# EasyEDA Pro project hardware.eprj, board PCB27
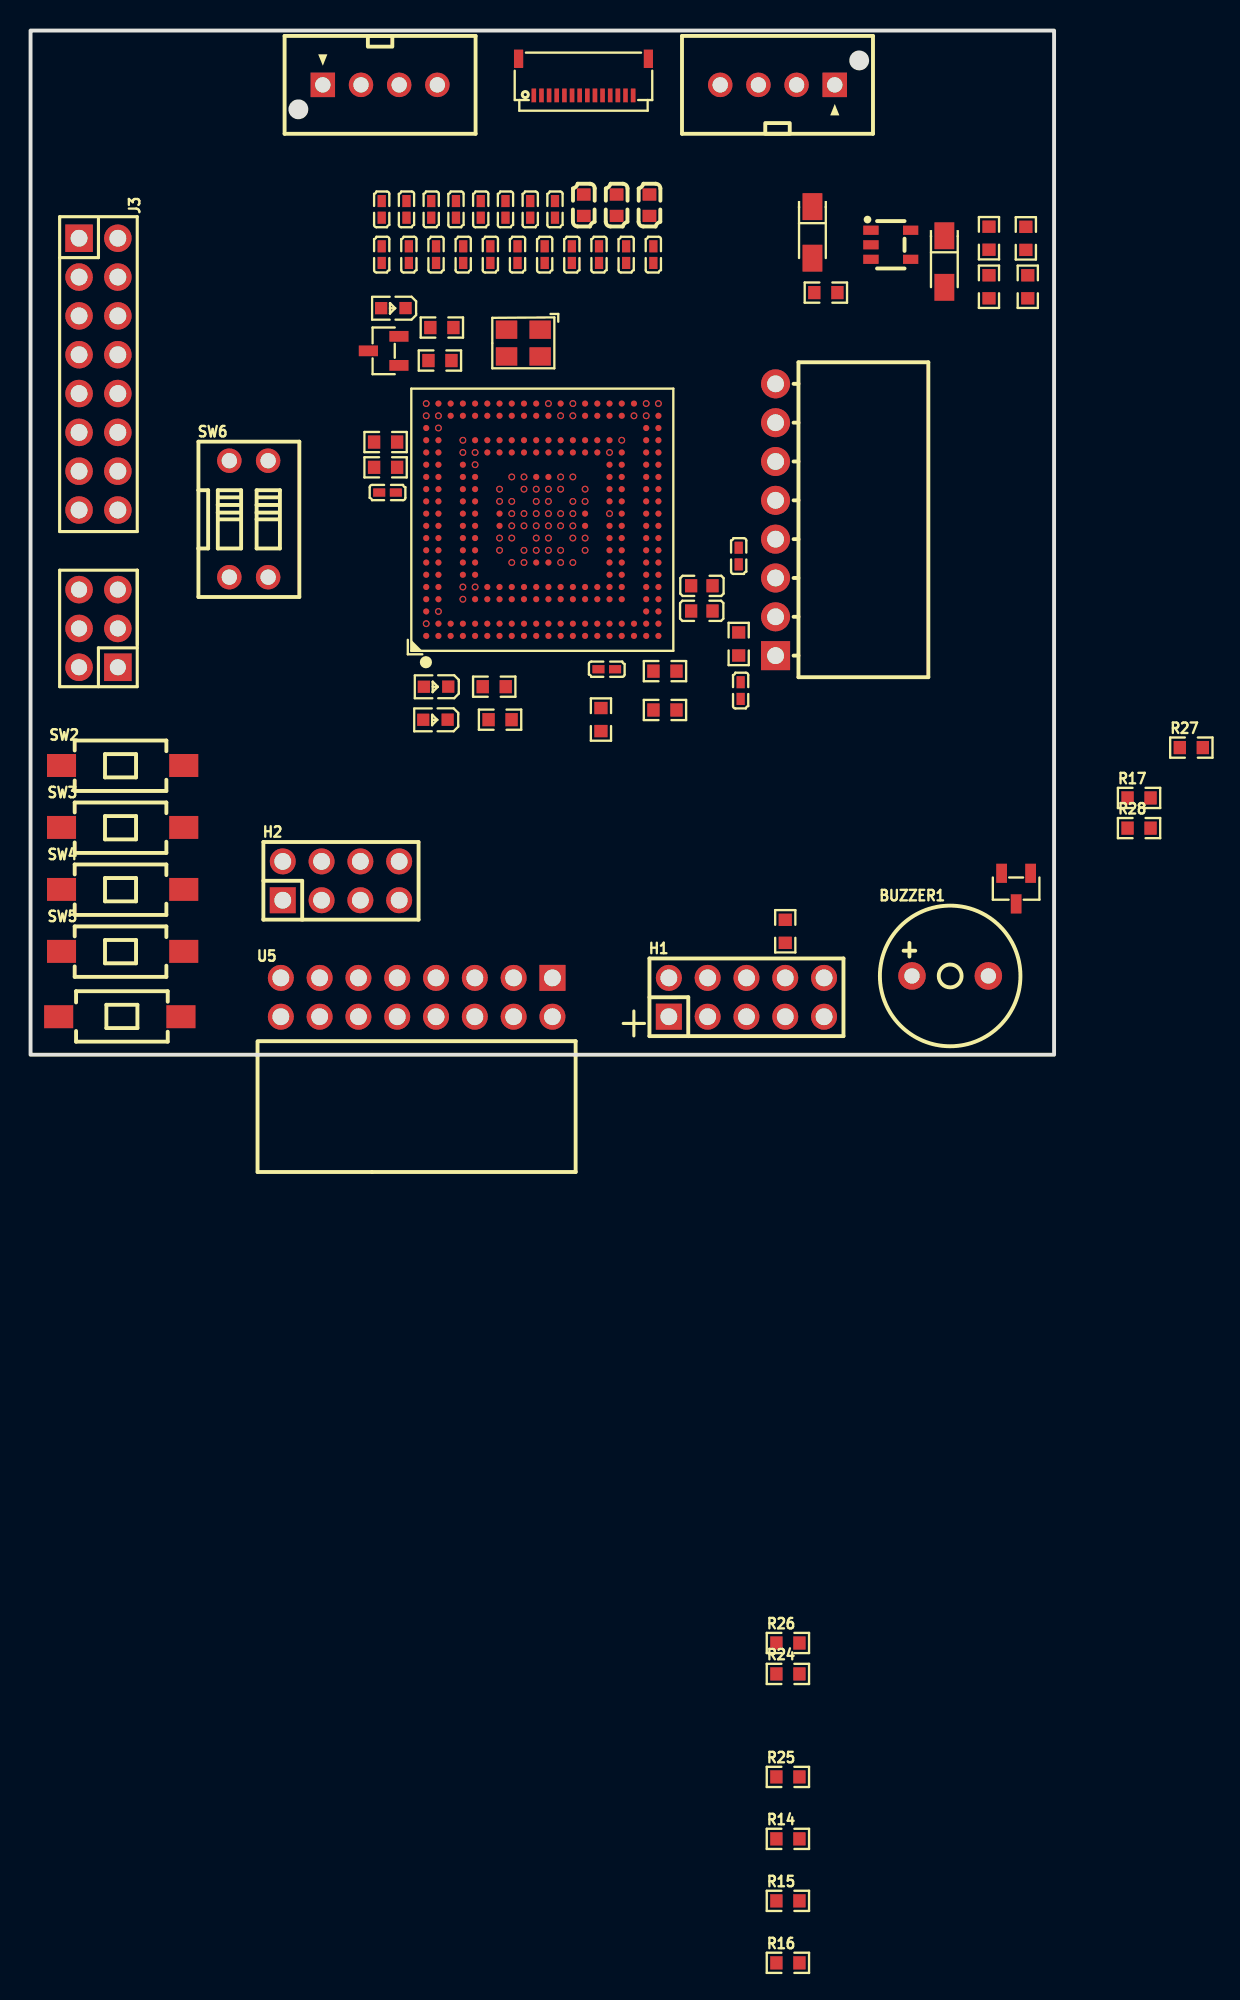
[diagram p10: board, top side]
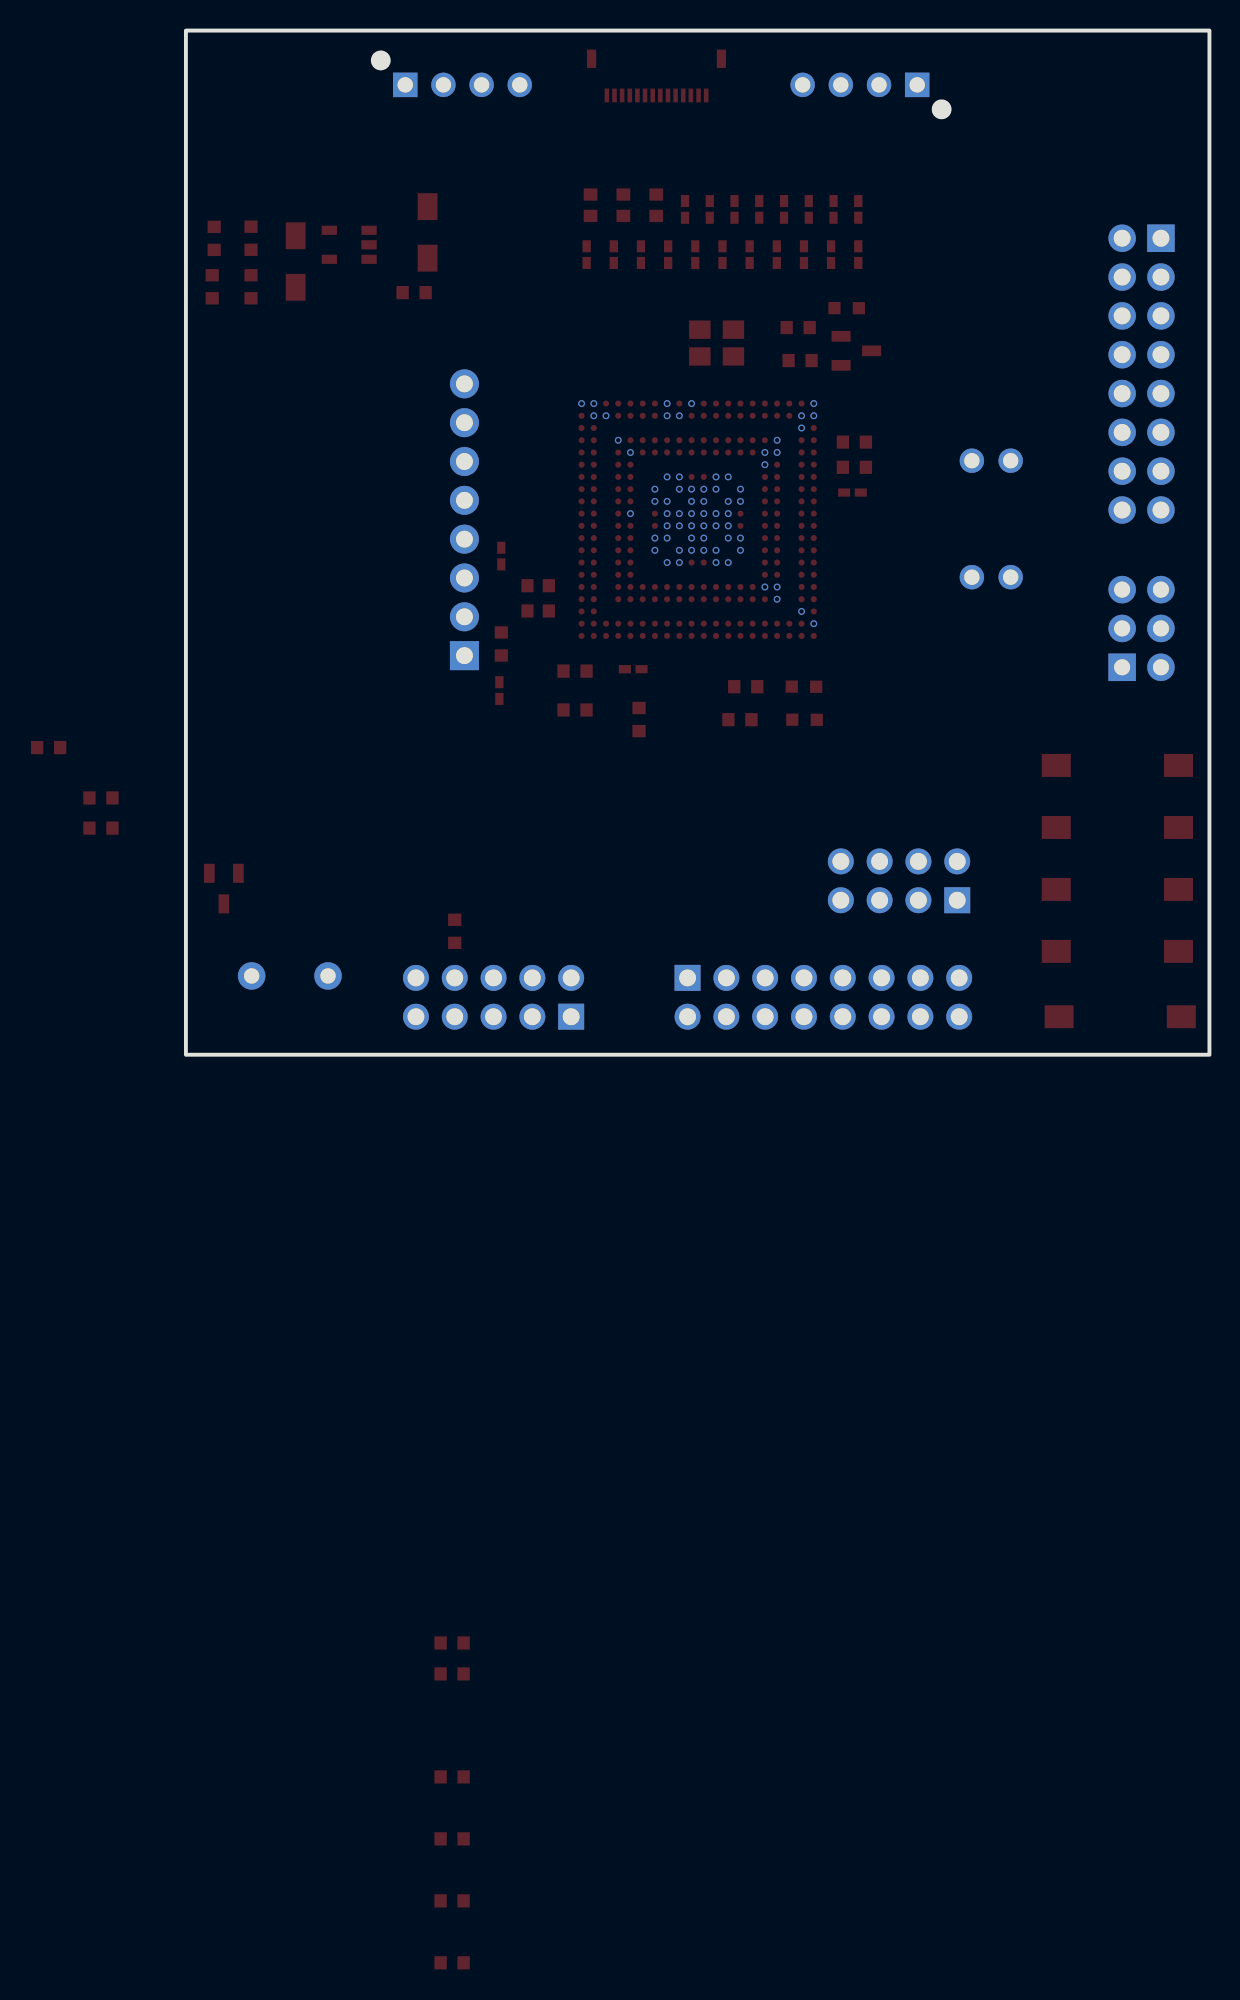
[diagram p11: board, bottom side, seen from below]

Outline 67 x 67 mm; copper layers: Top Layer, 1.3V, 3.3V, GND, Inner4, Bottom Layer. Coordinates in mm from the lower left corner of the outline.
Outline path: rectangle 0,67 67,0
Stack: Top Layer 0.035mm / Dielectric1 0.274mm PP er 4.5 / 1.3V 0.035mm / Dielectric2 0.274mm PP er 4.5 / 3.3V 0.035mm / Dielectric3 0.274mm FR4 er 4.5 / GND 0.035mm / Dielectric4 0.274mm PP er 4.5 / Inner4 0.035mm / Dielectric5 0.274mm PP er 4.5 / Bottom Layer 0.035mm

## Design rules (mm)
net $1N19046: DP1
net $1N19138: DP1
spacing safeClearance (default): track to track 0.152, other pairs 0.152 to 0.3
track width trackWidth (default): min 0.127, default 0.254, max 2.54
differential pair differentialPair (default): width min 0.127, default 0.254, max 2.54; gap min 0.152, default 0.152
via viaSize (default): diameter min 0.15, default 0.45, max 10; hole min 0.25, default 0.3, max 6

## Placement (name value [footprint] x y rotation side)
BUZZER1  3kHz  [BUZ-TH_BD9.0-P5.00-D0.6-FD]  60.2 5.16 0 top
C1  100nF  [C0402_NEW]  22.99 52.34 90 top
C2  100nF  [C0402_NEW]  24.76 52.34 90 top
C3  100nF  [C0402_NEW]  26.54 52.34 90 top
C4  100nF  [C0402_NEW]  28.32 52.34 90 top
C5  100nF  [C0402_NEW]  30.1 52.34 90 top
C6  100nF  [C0402_NEW]  31.88 52.34 90 top
C7  100nF  [C0402_NEW]  33.66 52.34 90 top
C8  100nF  [C0402_NEW]  35.43 52.34 90 top
C9  100nF  [C0402_NEW]  37.21 52.34 90 top
C10  100nF  [C0402_NEW]  24.61 55.3 270 top
C11  100nF  [C0402_NEW]  27.85 55.3 270 top
C12  100nF  [C0402_NEW]  31.09 55.3 270 top
C13  100nF  [C0402_NEW]  29.47 55.3 270 top
C14  100nF  [C0402_NEW]  26.23 55.3 270 top
C15  100nF  [C0402_NEW]  32.71 55.3 270 top
C16  100nF  [C0402_NEW]  22.99 55.3 270 top
C17  2.2uF  [C0603]  36.21 55.57 270 top
C18  47uF  [C0603]  38.36 55.57 270 top
C19  100nF  [C0402_NEW]  34.33 55.3 270 top
C20  100nF  [C0402_NEW]  40.77 52.34 90 top
C21  100nF  [C0402_NEW]  38.99 52.34 90 top
C22  47uF  [C0603]  40.51 55.57 270 top
C23  100nF  [C0402_NEW]  23.37 36.78 0 top
C24  100nF  [C0402_NEW]  37.72 25.22 0 top
C25  100nF  [C0402_NEW]  46.35 32.62 270 top
C26  100nF  [C0402_NEW]  46.48 23.82 90 top
C27  1uF  [CAP-SMD_L3.2-W1.6-RD]  59.82 51.89 270 top
C28  1uF  [CAP-SMD_L3.2-W1.6-RD]  51.18 53.8 270 top
CN1  B04B-XASK-1-A(LF)(SN)  [CONN-TH_B04B-XASK-1-A-LF-SN]  48.9 63.45 0 top
CN2  B04B-XASK-1-A(LF)(SN)  [CONN-TH_B04B-XASK-1-A-LF-SN]  22.88 63.45 180 top
F1  500Ω  [R0603]  23.24 40.08 180 top
FPC3  FH34SRJ-14S-0.5SH(50)  [FFC-SMD_14P-P0.50_FH34SRJ-14S-0.5SH]  36.19 63.96 180 top
H1  B-2100S10P-B110  [HDR-TH_10P-P2.54-V-M-R2-C5-S2.54]  46.86 3.76 0 top
H2  PZ254V-12-8P  [HDR-TH_8P-P2.54-V-M-R2-C4-S2.54]  20.32 11.38 0 top
J1  有刷电机编码器  [HDR-TH_6P-P2.54-V-M-R2-C3-S2.54-1]  4.44 27.89 90 top
J3  2.54-2*8P母  [HDR-TH_16P-P2.54-V-F-R2-C8-S2.54-1]  4.44 44.53 270 top
LED1  NCD0603R1  [LED0603-RD_RED]  23.75 48.84 180 top
LED2  NCD0603R1  [LED0603-RD_RED]  26.54 24.08 180 top
LED3  NCD0603R1  [LED0603-RD_RED]  26.51 21.92 180 top
Q1  MMBT5401  [SOT-23-3_L2.9-W1.3-P1.90-LS2.4-BR]  23.11 46.05 0 top
Q2  S9013-G  [SOT-23-3_L2.9-W1.3-P1.90-LS2.4-BR]  64.52 10.87 90 top
R1  10kΩ  [R0603]  23.24 38.43 180 top
R2  10kΩ  [R0603]  26.8 45.41 0 top
R3  1kΩ  [R0603]  26.92 47.57 0 top
R4  1kΩ  [R0603]  30.35 24.08 0 top
R5  1kΩ  [R0603]  30.73 21.92 0 top
R6  10kΩ  [R0603]  49.4 8.08 270 top
R7  0Ω  [R0603]  41.53 25.09 0 top
R8  0Ω  [R0603]  46.35 26.87 270 top
R9  0Ω  [R0603]  37.34 21.93 270 top
R10  0Ω  [R0603]  41.53 22.55 0 top
R12  0603WAF1201T5E  [R0603]  65.28 50.24 90 top
R13  100Ω  [R0603]  62.74 50.24 90 top
R14  0603WAF4701T5E  [R0603]  49.58 -51.3 0 top
R15  0603WAF4701T5E  [R0603]  49.58 -55.35 0 top
R16  0603WAF4701T5E  [R0603]  49.58 -59.41 0 top
R17  0603WAF4701T5E  [R0603]  72.56 16.8 0 top
R18  10kΩ  [R0603]  52.06 49.86 0 top
R21  0603WAF1201T5E  [R0603]  65.15 53.41 90 top
R22  100Ω  [R0603]  62.74 53.42 90 top
R24  0603WAF4701T5E  [R0603]  49.58 -40.51 0 top
R25  0603WAF4701T5E  [R0603]  49.58 -47.24 0 top
R26  0603WAF4701T5E  [R0603]  49.58 -38.48 0 top
R27  0603WAF100JT5E  [R0603]  75.99 20.09 0 top
R28  10kΩ  [R0603]  72.56 14.83 0 top
SW1  TS-1101-C-W  [SW-SMD_L6.0-W3.3-LS8.0]  5.84 2.49 180 top
SW2  TS-1101-C-W  [SW-SMD_L6.0-W3.3-LS8.0]  6.03 18.92 0 top
SW3  TS-1101-C-W  [SW-SMD_L6.0-W3.3-LS8.0]  6.03 14.87 0 top
SW4  TS-1101-C-W  [SW-SMD_L6.0-W3.3-LS8.0]  6.03 10.82 0 top
SW5  TS-1101-C-W  [SW-SMD_L6.0-W3.3-LS8.0]  6.03 6.76 0 top
SW6  DS-02RP  [SW-TH_DS-02XP]  14.28 35.05 0 top
U1  TC377TP96F300SAAKXUMA1  [PG-LFBGA-292_L17.0-W17.0-P0.80-BL_INFINEON_SAK-TC29XXXX]  33.5 35 0 top
U2  CBM160808U501T  [L0603]  43.94 30.68 180 top
U3  CBM160808U501T  [L0603]  43.94 29.03 0 top
U4  RT9043GB  [SOT-23-5_L3.0-W1.7-P0.95-LS2.8-BR]  56.31 52.99 180 top
U5  DW254W-22-16-85  [HDR-TH_16P-P2.54-H-F-R2-C8-S2.54-W12.7-N]  25.27 3.76 0 top
U6  PM254-1-08-W-8.5  [HDR-TH_8P-P2.54-H-F-W10.0-N]  48.77 35 90 top
X1  20MHz  [OSC-SMD_4P-L3.2-W2.5-BL]  32.26 46.56 180 top

## Footprints (pads in the part's own frame, mm; a bottom-side part is the same pattern mirrored in y, then rotated)
BUZ-TH_BD9.0-P5.00-D0.6-FD
  round 1.801 hole 1.001: 1(-2.499,0) 2(2.499,0)
C0402_NEW
  rect 0.79x0.54 smd: 1(-0.545,0) 2(0.545,0)
C0603
  rect 0.8x0.9 smd: 1(-0.7,0) 2(0.7,0)
CAP-SMD_L3.2-W1.6-RD
  rect 1.758x1.296 smd: 1(-1.687,0) 2(1.687,0)
CONN-TH_B04B-XASK-1-A-LF-SN
  rect 1.6x1.6 hole 1.001: 1(3.749,0)
  round 1.6 hole 1.001: 2(1.25,0) 3(-1.25,0) 4(-3.749,0)
FFC-SMD_14P-P0.50_FH34SRJ-14S-0.5SH
  rect 0.299x0.899 smd: 1(3.251,1.199) 2(2.751,1.199) 3(2.251,1.199) 4(1.75,1.199) 5(1.25,1.199) 6(0.75,1.199) 7(0.249,1.199) 8(-0.249,1.199) 9(-0.75,1.199) 10(-1.25,1.199) 11(-1.75,1.199) 12(-2.251,1.199) 13(-2.751,1.199) 14(-3.251,1.199)
  rect 0.6x1.199 smd: 15(-4.25,-1.199) 16(4.25,-1.199)
HDR-TH_6P-P2.54-V-M-R2-C3-S2.54-1
  rect 1.801x1.801 hole 1.049: 1(-2.54,-1.27)
  round 1.801 hole 1.049: 2(-2.54,1.27) 3(0,-1.27) 4(0,1.27) 5(2.54,-1.27) 6(2.54,1.27)
HDR-TH_8P-P2.54-H-F-W10.0-N
  rect 1.9x1.9 hole 1.1: 1(-8.89,0)
  round 1.9 hole 1.1: 2(-6.35,0) 3(-3.81,0) 4(-1.27,0) 5(1.27,0) 6(3.81,0) 7(6.35,0) 8(8.89,0)
HDR-TH_8P-P2.54-V-M-R2-C4-S2.54
  rect 1.7x1.7 hole 1.1: 1(-3.81,-1.27)
  round 1.7 hole 1.1: 2(-3.81,1.27) 3(-1.27,-1.27) 4(-1.27,1.27) 5(1.27,-1.27) 6(1.27,1.27) 7(3.81,-1.27) 8(3.81,1.27)
HDR-TH_10P-P2.54-V-M-R2-C5-S2.54
  rect 1.7x1.7 hole 1.1: 1(-5.08,-1.27)
  round 1.7 hole 1.1: 2(-5.08,1.27) 3(-2.54,-1.27) 4(-2.54,1.27) 5(0,-1.27) 6(0,1.27) 7(2.54,-1.27) 8(2.54,1.27) 9(5.08,-1.27) 10(5.08,1.27)
HDR-TH_16P-P2.54-H-F-R2-C8-S2.54-W12.7-N
  rect 1.7x1.7 hole 1.1: 1(8.89,1.27)
  round 1.7 hole 1.1: 2(8.89,-1.27) 3(6.35,1.27) 4(6.35,-1.27) 5(3.81,1.27) 6(3.81,-1.27) 7(1.27,1.27) 8(1.27,-1.27) 9(-1.27,1.27) 10(-1.27,-1.27) 11(-3.81,1.27) 12(-3.81,-1.27) 13(-6.35,1.27) 14(-6.35,-1.27) 15(-8.89,1.27) 16(-8.89,-1.27)
HDR-TH_16P-P2.54-V-F-R2-C8-S2.54-1
  rect 1.8x1.8 hole 1.1: 1(-8.89,-1.27)
  round 1.8 hole 1.1: 2(-8.89,1.27) 3(-6.35,-1.27) 4(-6.35,1.27) 5(-3.81,-1.27) 6(-3.81,1.27) 7(-1.27,-1.27) 8(-1.27,1.27) 9(1.27,-1.27) 10(1.27,1.27) 11(3.81,-1.27) 12(3.81,1.27) 13(6.35,-1.27) 14(6.35,1.27) 15(8.89,-1.27) 16(8.89,1.27)
L0603
  rect 0.8x0.864 smd: 1(-0.7,0) 2(0.7,0)
LED0603-RD_RED
  rect 0.8x0.8 smd: 1(-0.799,-0.004) 2(0.799,0.004)
OSC-SMD_4P-L3.2-W2.5-BL
  rect 1.4x1.2 smd: 1(-1.1,-0.875) 2(1.1,-0.875) 3(1.1,0.875) 4(-1.1,0.875)
PG-LFBGA-292_L17.0-W17.0-P0.80-BL_INFINEON_SAK-TC29XXXX
  round 0.4 smd: A1(-7.6,-7.6) A2(-7.6,-6.8) A3(-7.6,-6) A4(-7.6,-5.2) A5(-7.6,-4.4) A6(-7.6,-3.6) A7(-7.6,-2.8) A8(-7.6,-2) A9(-7.6,-1.2) A10(-7.6,-0.4) A11(-7.6,0.4) A12(-7.6,1.2) A13(-7.6,2) A14(-7.6,2.8) A15(-7.6,3.6) A16(-7.6,4.4) A17(-7.6,5.2) A18(-7.6,6) A19(-7.6,6.8) A20(-7.6,7.6) B1(-6.8,-7.6) B2(-6.8,-6.8) B3(-6.8,-6) B4(-6.8,-5.2) B5(-6.8,-4.4) B6(-6.8,-3.6) B7(-6.8,-2.8) B8(-6.8,-2) B9(-6.8,-1.2) B10(-6.8,-0.4) B11(-6.8,0.4) B12(-6.8,1.2) B13(-6.8,2) B14(-6.8,2.8) B15(-6.8,3.6) B16(-6.8,4.4) B17(-6.8,5.2) B18(-6.8,6) B19(-6.8,6.8) B20(-6.8,7.6) C1(-6,-7.6) C2(-6,-6.8) C19(-6,6.8) C20(-6,7.6) D1(-5.2,-7.6) D2(-5.2,-6.8) D4(-5.2,-5.2) D5(-5.2,-4.4) D6(-5.2,-3.6) D7(-5.2,-2.8) D8(-5.2,-2) D9(-5.2,-1.2) D10(-5.2,-0.4) D11(-5.2,0.4) D12(-5.2,1.2) D13(-5.2,2) D14(-5.2,2.8) D15(-5.2,3.6) D16(-5.2,4.4) D17(-5.2,5.2) D19(-5.2,6.8) D20(-5.2,7.6) E1(-4.4,-7.6) E2(-4.4,-6.8) E4(-4.4,-5.2) E5(-4.4,-4.4) E6(-4.4,-3.6) E7(-4.4,-2.8) E8(-4.4,-2) E9(-4.4,-1.2) E10(-4.4,-0.4) E11(-4.4,0.4) E12(-4.4,1.2) E13(-4.4,2) E14(-4.4,2.8) E15(-4.4,3.6) E16(-4.4,4.4) E17(-4.4,5.2) E19(-4.4,6.8) E20(-4.4,7.6) F1(-3.6,-7.6) F2(-3.6,-6.8) F4(-3.6,-5.2) F5(-3.6,-4.4) F16(-3.6,4.4) F17(-3.6,5.2) F19(-3.6,6.8) F20(-3.6,7.6) G1(-2.8,-7.6) G2(-2.8,-6.8) G4(-2.8,-5.2) G5(-2.8,-4.4) G8(-2.8,-2) G9(-2.8,-1.2) G10(-2.8,-0.4) G11(-2.8,0.4) G12(-2.8,1.2) G13(-2.8,2) G16(-2.8,4.4) G17(-2.8,5.2) G19(-2.8,6.8) G20(-2.8,7.6) H1(-2,-7.6) H2(-2,-6.8) H4(-2,-5.2) H5(-2,-4.4) H7(-2,-2.8) H9(-2,-1.2) H10(-2,-0.4) H11(-2,0.4) H12(-2,1.2) H14(-2,2.8) H16(-2,4.4) H17(-2,5.2) H19(-2,6.8) H20(-2,7.6) J1(-1.2,-7.6) J2(-1.2,-6.8) J4(-1.2,-5.2) J5(-1.2,-4.4) J7(-1.2,-2.8) J8(-1.2,-2) J10(-1.2,-0.4) J11(-1.2,0.4) J13(-1.2,2) J14(-1.2,2.8) J16(-1.2,4.4) J17(-1.2,5.2) J19(-1.2,6.8) J20(-1.2,7.6) K1(-0.4,-7.6) K2(-0.4,-6.8) K4(-0.4,-5.2) K5(-0.4,-4.4) K7(-0.4,-2.8) K8(-0.4,-2) K9(-0.4,-1.2) K10(-0.4,-0.4) K11(-0.4,0.4) K12(-0.4,1.2) K13(-0.4,2) K14(-0.4,2.8) K16(-0.4,4.4) K17(-0.4,5.2) K19(-0.4,6.8) K20(-0.4,7.6) L1(0.4,-7.6) L2(0.4,-6.8) L4(0.4,-5.2) L5(0.4,-4.4) L7(0.4,-2.8) L8(0.4,-2) L9(0.4,-1.2) L10(0.4,-0.4) L11(0.4,0.4) L12(0.4,1.2) L13(0.4,2) L14(0.4,2.8) L16(0.4,4.4) L17(0.4,5.2) L19(0.4,6.8) L20(0.4,7.6) M1(1.2,-7.6) M2(1.2,-6.8) M4(1.2,-5.2) M5(1.2,-4.4) M7(1.2,-2.8) M8(1.2,-2) M10(1.2,-0.4) M11(1.2,0.4) M13(1.2,2) M14(1.2,2.8) M16(1.2,4.4) M17(1.2,5.2) M19(1.2,6.8) M20(1.2,7.6) N1(2,-7.6) N2(2,-6.8) N4(2,-5.2) N5(2,-4.4) N7(2,-2.8) N9(2,-1.2) N10(2,-0.4) N11(2,0.4) N12(2,1.2) N14(2,2.8) N16(2,4.4) N17(2,5.2) N19(2,6.8) N20(2,7.6) P1(2.8,-7.6) P2(2.8,-6.8) P4(2.8,-5.2) P5(2.8,-4.4) P8(2.8,-2) P9(2.8,-1.2) P10(2.8,-0.4) P11(2.8,0.4) P12(2.8,1.2) P13(2.8,2) P16(2.8,4.4) P17(2.8,5.2) P19(2.8,6.8) P20(2.8,7.6) R1(3.6,-7.6) R2(3.6,-6.8) R4(3.6,-5.2) R5(3.6,-4.4) R16(3.6,4.4) R17(3.6,5.2) R19(3.6,6.8) R20(3.6,7.6) T1(4.4,-7.6) T2(4.4,-6.8) T4(4.4,-5.2) T5(4.4,-4.4) T6(4.4,-3.6) T7(4.4,-2.8) T8(4.4,-2) T9(4.4,-1.2) T10(4.4,-0.4) T11(4.4,0.4) T12(4.4,1.2) T13(4.4,2) T14(4.4,2.8) T15(4.4,3.6) T16(4.4,4.4) T17(4.4,5.2) T19(4.4,6.8) T20(4.4,7.6) U1(5.2,-7.6) U2(5.2,-6.8) U4(5.2,-5.2) U5(5.2,-4.4) U6(5.2,-3.6) U7(5.2,-2.8) U8(5.2,-2) U9(5.2,-1.2) U10(5.2,-0.4) U11(5.2,0.4) U12(5.2,1.2) U13(5.2,2) U14(5.2,2.8) U15(5.2,3.6) U16(5.2,4.4) U17(5.2,5.2) U19(5.2,6.8) U20(5.2,7.6) V1(6,-7.6) V2(6,-6.8) V19(6,6.8) V20(6,7.6) W1(6.8,-7.6) W2(6.8,-6.8) W3(6.8,-6) W4(6.8,-5.2) W5(6.8,-4.4) W6(6.8,-3.6) W7(6.8,-2.8) W8(6.8,-2) W9(6.8,-1.2) W10(6.8,-0.4) W11(6.8,0.4) W12(6.8,1.2) W13(6.8,2) W14(6.8,2.8) W15(6.8,3.6) W16(6.8,4.4) W17(6.8,5.2) W18(6.8,6) W19(6.8,6.8) W20(6.8,7.6) Y1(7.6,-7.6) Y2(7.6,-6.8) Y3(7.6,-6) Y4(7.6,-5.2) Y5(7.6,-4.4) Y6(7.6,-3.6) Y7(7.6,-2.8) Y8(7.6,-2) Y9(7.6,-1.2) Y10(7.6,-0.4) Y11(7.6,0.4) Y12(7.6,1.2) Y13(7.6,2) Y14(7.6,2.8) Y15(7.6,3.6) Y16(7.6,4.4) Y17(7.6,5.2) Y18(7.6,6) Y19(7.6,6.8) Y20(7.6,7.6)
R0603
  rect 0.806x0.864 smd: 1(-0.753,0) 2(0.753,0)
SOT-23-3_L2.9-W1.3-P1.90-LS2.4-BR
  rect 1.25x0.7 smd: 1(1,-0.95) 2(1,0.95) 3(-1,0)
SOT-23-5_L3.0-W1.7-P0.95-LS2.8-BR
  rect 1x0.6 smd: 1(1.3,-0.95) 2(1.3,0) 3(1.3,0.95) 4(-1.3,0.95) 5(-1.3,-0.95)
SW-SMD_L6.0-W3.3-LS8.0
  rect 1.9x1.5 smd: 1(-4,0) 2(4,0)
SW-TH_DS-02XP
  round 1.6 hole 1: 1(-1.27,3.81) 2(1.27,3.81) 3(1.27,-3.81) 4(-1.27,-3.81)

## Nets
As in the schematic.

Pads without a net: H2 2 8; J1 5 6; U1 A1 A3 A7 A10 A13 A14 A16 B4 B6 B10 B13 B14 B15 D1 D6 D7 D8 D9 D10 D11 D12 D13 D14 D15 E4 E6 E7 E8 E9 E10 E11 E12 E13 E17 E19 F2 F4 F5 F17 F19 F20 G4 G5 G10 G11 G16 G19 H4 H5 H17 H19 J5 J17 J20 K4 K5 K14 K17 L1 L2 L4 L5 M1 M2 M4 M5 M16 M17 N1 N2 N4 N5 N16 N17 P1 P2 P4 P5 P16 P17 P19 P20 R1 R2 R4 R5 R16 R17 T4 T5 T6 T7 T8 T9 T12 T13 T14 T15 T17 T19 T20 U1 U2 U4 U5 U6 U7 U8 U9 U11 U12 U13 U14 U15 U16 U20 V1 V2 V20 W1 W2 W3 W4 W5 W6 W7 W8 W9 W10 W11 W16 W17 W18 Y1 Y2 Y3 Y8 Y9 Y10 Y11 Y15 Y16 Y17 Y18 Y19; U5 10; U6 7 8

## Via types
v1: diameter 0.45, hole 0.3, Top Layer to Bottom Layer, 68 vias

## Routing (per net, layer and track width the routed paths; a pad name or vN(x,y) marks a point on that pad's centre or on a via; arc(x,y) is an arc through that point)
1.3V:
  vias: v1(28.3,39.4) v1(29.1,38.6) v1(30.7,37) v1(30.7,33) v1(31.5,37.8) v1(31.5,32.2) v1(35.5,41.8) v1(35.5,37.8) v1(35.5,32.2) v1(36.3,37) v1(36.3,33)
3.3V:
  vias: v1(25.9,41.8) v1(25.9,28.2) v1(26.7,41) v1(26.7,29) v1(28.3,30.6) v1(35.5,42.6) v1(37.9,35.4) v1(39.5,41.8) v1(40.3,42.6)
GND_CORE:
  vias: v1(25.9,42.6) v1(26.7,41.8) v1(28.3,40.2) v1(28.3,29.8) v1(29.1,39.4) v1(29.1,30.6) v1(30.7,36.2) v1(30.7,33.8) v1(31.5,36.2) v1(31.5,35.4) v1(31.5,34.6) v1(31.5,33.8) v1(32.3,37.8) v1(32.3,37) v1(32.3,35.4) v1(32.3,34.6) v1(32.3,33) v1(32.3,32.2) v1(33.1,37) v1(33.1,36.2) v1(33.1,35.4) v1(33.1,34.6) v1(33.1,33.8) v1(33.1,33) v1(33.9,42.6) v1(33.9,37) v1(33.9,36.2) v1(33.9,35.4) v1(33.9,34.6) v1(33.9,33.8) v1(33.9,33) v1(34.7,37.8) v1(34.7,37) v1(34.7,35.4) v1(34.7,34.6) v1(34.7,33) v1(34.7,32.2) v1(35.5,36.2) v1(35.5,35.4) v1(35.5,34.6) v1(35.5,33.8) v1(36.3,36.2) v1(36.3,33.8) v1(37.9,39.4) v1(38.7,40.2) v1(40.3,41.8) v1(41.1,42.6)
$1N19138:
  vias: v1(34.7,41.8)

## Copper pours and planes (outline as drawn; the poured copper is in the pictures)
1.3V on 1.3V: 0.26,66.74 66.74,66.74 66.74,0.26 0.26,0.26
3.3V on 3.3V: 0.26,66.74 66.74,66.74 66.74,0.26 0.26,0.26
GND_CORE on GND: 0.26,66.74 66.74,66.74 66.74,0.26 0.26,0.26

Small or netless copper shapes (teardrops, artwork), in the pictures only: 9 on 1.3V, 9 on 3.3V

## Text on the board
Top Silkscreen Layer: +
